# Altium schematic sheet Serial.SchDoc: Apalis Evaluation Board 1.1
size A3; Organization: Toradex AG; Address1: Altsagenstrasse 5; Address2: Horw; Address3: 6048; Address4: Switzerland; DocumentNumber: 24; Revision: V1.1; SheetNumber: 24; SheetTotal: 32; PageSetup: Record=PageOptions|CenterHorizontal=True|CenterVertical=True|PrintScale=0.73|XCorrection=1.00|YCorrection=1.00|PrintKind=0|BorderSize=5000000|LeftOffset=0|BottomOffset=0|Orientation=2|PaperLength=1000|PaperWidth=1000|Scale=100|PaperSource=7|PrintQuality=-4|MediaType=1|DitherType=10|PaperKind=A4|PrintScaleMode=1
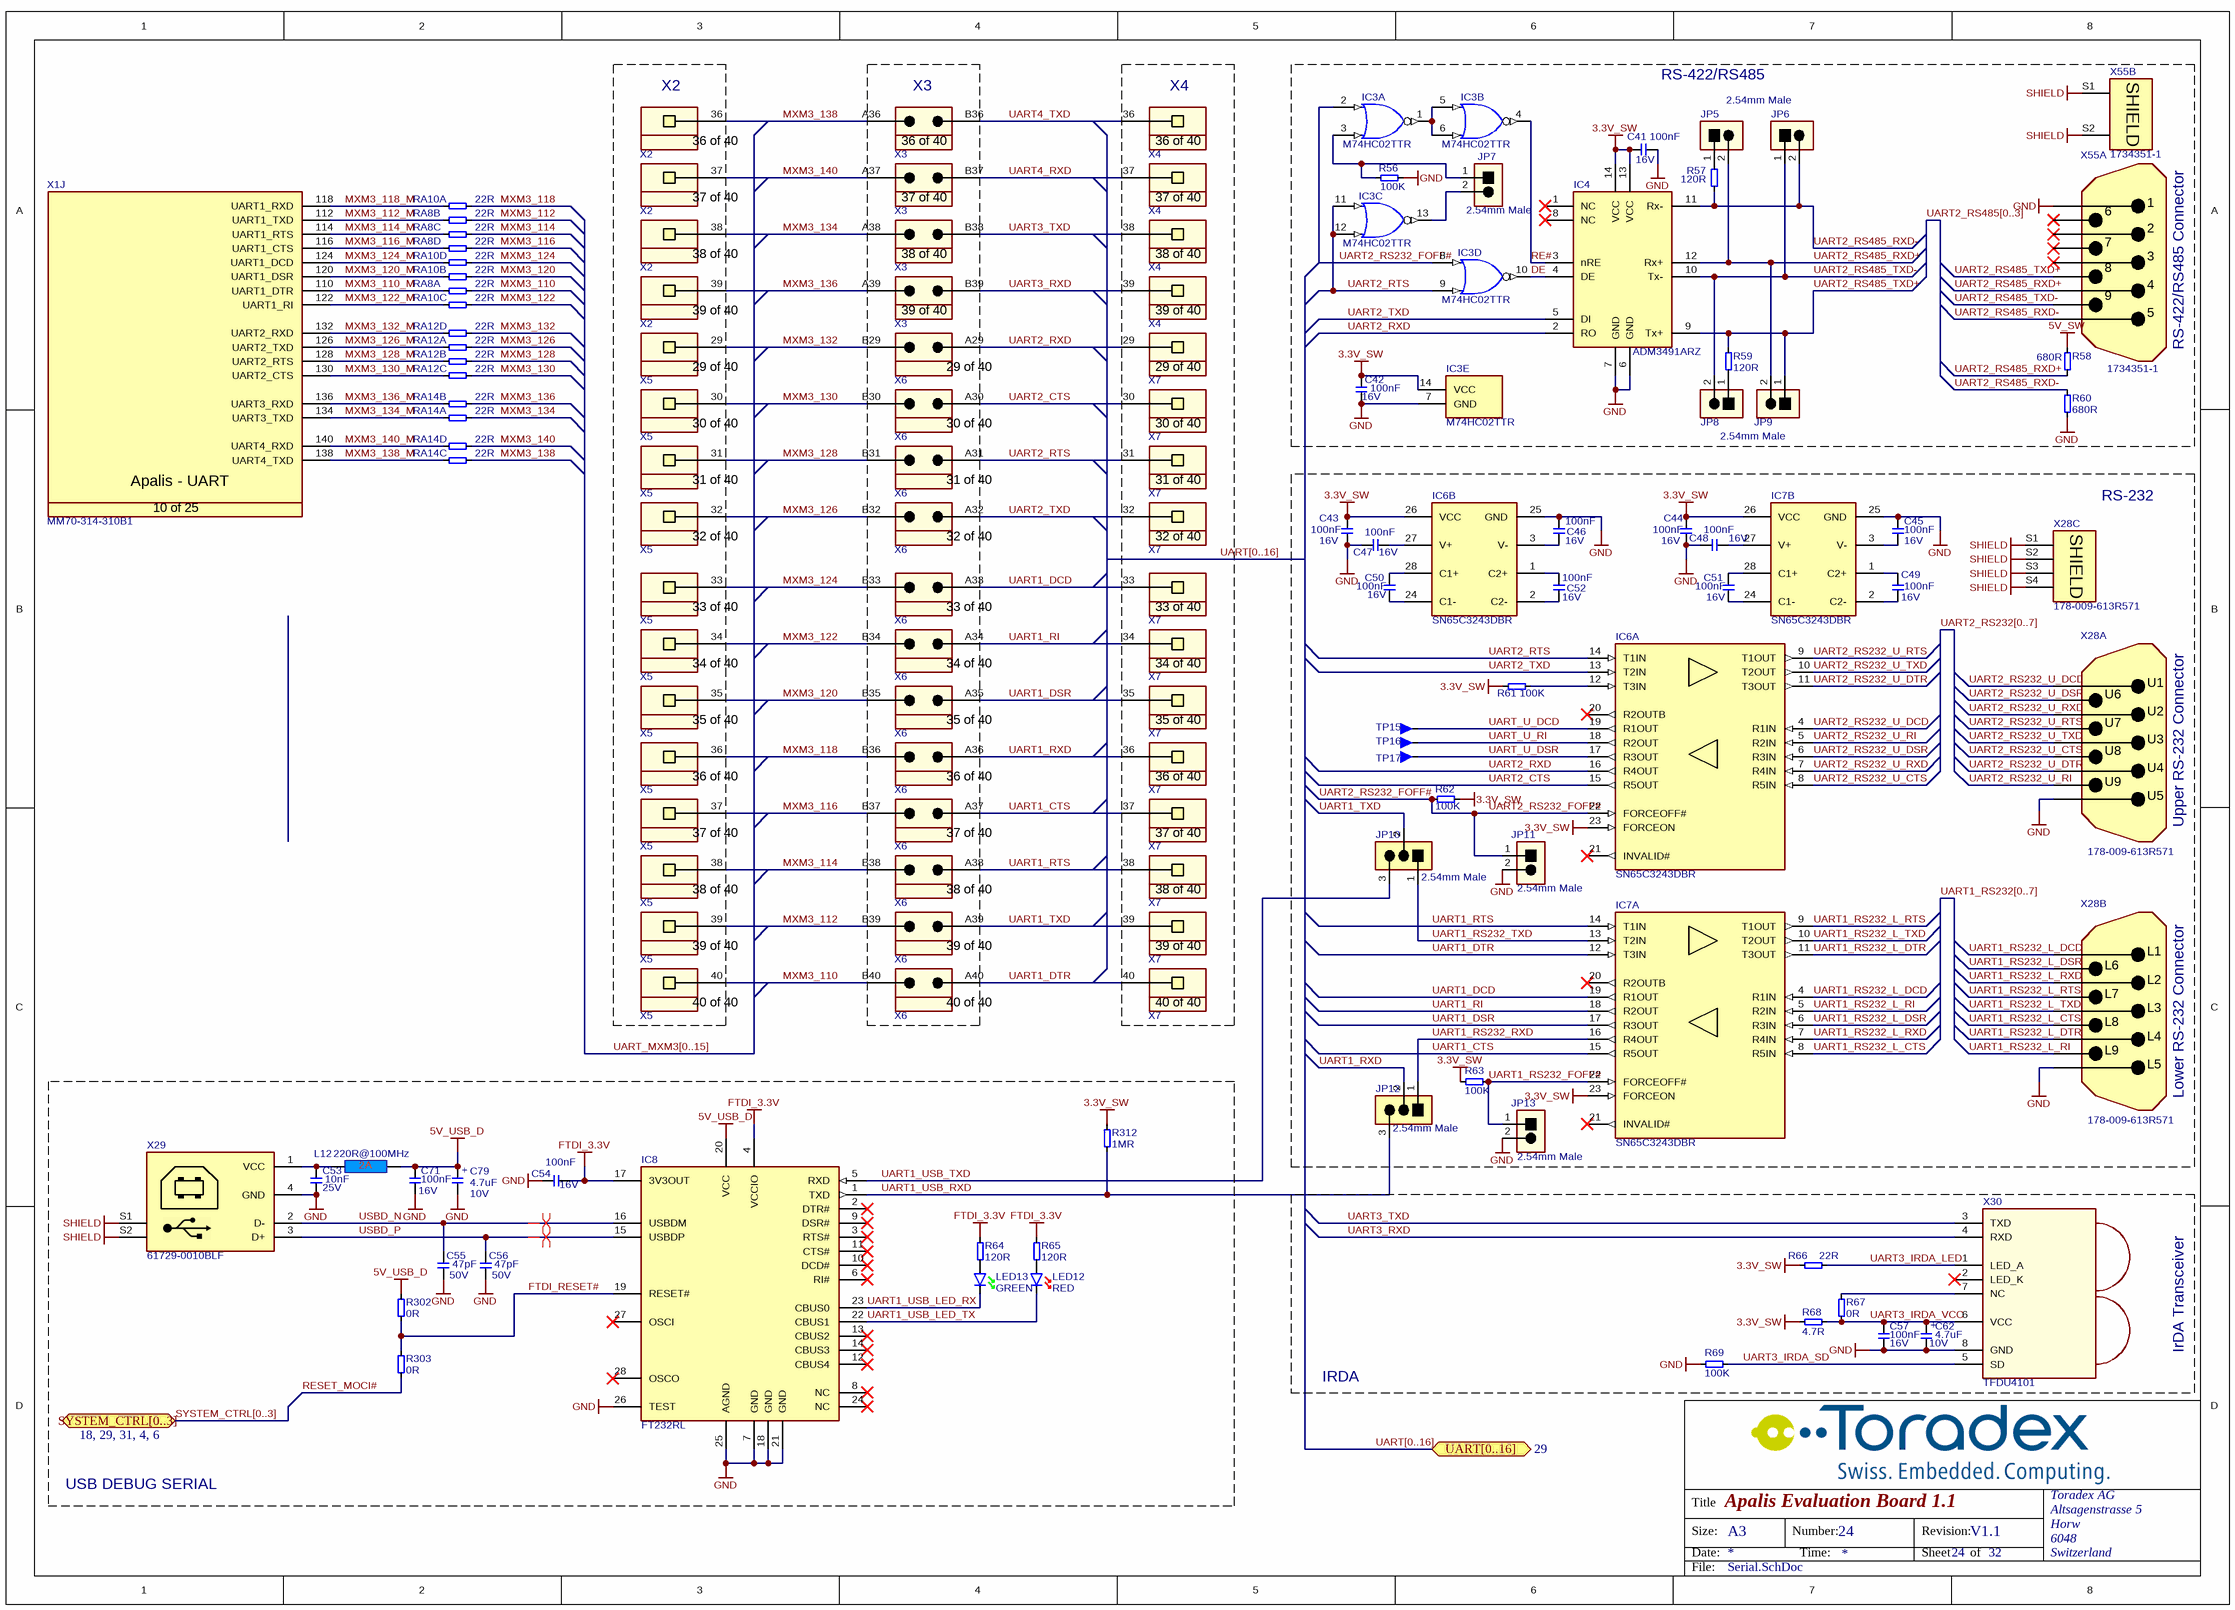
[diagram p0: Serial.SchDoc]

## Parts
C41  Rating: 16V  [T_CAPC0603X33N]  (hidden comment: 100nF)
C42  Rating: 16V  [T_CAPC0603X33N]  (hidden comment: 100nF)
C43  Rating: 16V  [T_CAPC0603X33N]  (hidden comment: 100nF)
C44  Rating: 16V  [T_CAPC0603X33N]  (hidden comment: 100nF)
C45  Rating: 16V  [T_CAPC0603X33N]  (hidden comment: 100nF)
C46  Rating: 16V  [T_CAPC0603X33N]  (hidden comment: 100nF)
C47  Rating: 16V  [T_CAPC0603X33N]  (hidden comment: 100nF)
C48  Rating: 16V  [T_CAPC0603X33N]  (hidden comment: 100nF)
C49  Rating: 16V  [T_CAPC0603X33N]  (hidden comment: 100nF)
C50  Rating: 16V  [T_CAPC0603X33N]  (hidden comment: 100nF)
C51  Rating: 16V  [T_CAPC0603X33N]  (hidden comment: 100nF)
C52  Rating: 16V  [T_CAPC0603X33N]  (hidden comment: 100nF)
C53  Rating: 25V  [T_CAPC0603X33N]  (hidden comment: 10nF)
C54  Rating: 16V  [T_CAPC0603X33N]  (hidden comment: 100nF)
C55  Rating: 50V  [T_CAPC0603X33N]  (hidden comment: 47pF)
C56  Rating: 50V  [T_CAPC0603X33N]  (hidden comment: 47pF)
C57  Rating: 16V  [T_CAPC0603X33N]  (hidden comment: 100nF)
C62  Rating: 10V  [T_CAPMP3216X180N]  (hidden comment: 4.7uF)
C71  Rating: 16V  [T_CAPC0603X33N]  (hidden comment: 100nF)
C79  Rating: 10V  [T_CAPMP3216X180N]  (hidden comment: 4.7uF)
IC3  M74HC02TTR  [T_ST_M74HC02TTR]  (parts A,B,C,D,E of 5)
IC4  ADM3491ARZ  [SOIC127P600X175-14N]
IC6  SN65C3243DBR  [SOP65P780X200-28N]  (parts A,B of 2)
IC7  SN65C3243DBR  [SOP65P780X200-28N]  (parts A,B of 2)
IC8  FT232RL  [T_FTDI_FT232RL]
JP5  TSW-101-07-G-D  [T_Samtec_TSW-101-07-G-D]  (value not drawn)
JP6  TSW-101-07-G-D  [T_Samtec_TSW-101-07-G-D]  (value not drawn)
JP7  TSW-101-07-G-D  [T_Samtec_TSW-101-07-G-D]  (value not drawn)
JP8  TSW-101-07-G-D  [T_Samtec_TSW-101-07-G-D]  (value not drawn)
JP9  TSW-101-07-G-D  [T_Samtec_TSW-101-07-G-D]  (value not drawn)
JP10  826936-3  [T_TYCO_826936-3]  (value not drawn)
JP11  TSW-101-07-G-D  [T_Samtec_TSW-101-07-G-D]  (value not drawn)
JP12  826936-3  [T_TYCO_826936-3]  (value not drawn)
JP13  TSW-101-07-G-D  [T_Samtec_TSW-101-07-G-D]  (value not drawn)
L12  220R@100MHz  [INDC1608X95N]
LED12  Color: RED  [T_Osram_T670_RED]  (hidden comment: LS T670-K1L2-1)
LED13  Color: GREEN  [T_Osram_T670_GREEN]  (hidden comment: LG T670-K1L2-1)
R56  100K  [T_RESC0603X30N]
R57  120R  [T_RESC0603X30N]
R58  680R  [T_RESC0603X30N]
R59  120R  [T_RESC0603X30N]
R60  680R  [T_RESC0603X30N]
R61  100K  [T_RESC0603X30N]
R62  100K  [T_RESC0603X30N]
R63  100K  [T_RESC0603X30N]
R64  120R  [T_RESC0603X30N]
R65  120R  [T_RESC0603X30N]
R66  22R  [T_RESC0603X30N]
R67  0R  [T_RESC0603X30N]
R68  4.7R  [RESC1005X40N]
R69  100K  [T_RESC0603X30N]
R302  0R  [T_RESC0603X30N]
R303  0R  [T_RESC0603X30N]
R312  1MR  [T_RESC0603X30N]
RA8  22R  [T_Resistor_Array_X4]  (parts A,B,C,D of 4)
RA10  22R  [T_Resistor_Array_X4]  (parts A,B,C,D of 4)
RA12  22R  [T_Resistor_Array_X4]  (parts A,B,C,D of 4)
RA14  22R  [T_Resistor_Array_X4]  (parts A,B,C,D of 4)
TP15  Testpin  [T_TP-THT]  (value not drawn)
TP16  Testpin  [T_TP-THT]  (value not drawn)
TP17  Testpin  [T_TP-THT]  (value not drawn)
X1  Manufacturer Part No.: MM70-314-310B1  [T_JAE_MM70-314-310B1]  (hidden comment: CON-JAE-MM70-314-310B1-314-0.5mm)  (part J of 25)
X2  SSW-110-01-G-S  [T_Samtec_SSW-110-01-G-S]  (value not drawn)  (parts 36,37,38,39 of 40)
X3  TSW-110-07-G-D  [T_Samtec_TSW-110-07-G-D]  (value not drawn)  (parts 36,37,38,39 of 40)
X4  SSW-110-01-G-S  [T_Samtec_SSW-110-01-G-S]  (value not drawn)  (parts 36,37,38,39 of 40)
X5  SSW-110-01-G-S  [T_Samtec_SSW-110-01-G-S]  (value not drawn)  (parts 29,30,31,32,33,34,35,36,37,38,39,40 of 40)
X6  TSW-110-07-G-D  [T_Samtec_TSW-110-07-G-D]  (value not drawn)  (parts 29,30,31,32,33,34,35,36,37,38,39,40 of 40)
X7  SSW-110-01-G-S  [T_Samtec_SSW-110-01-G-S]  (value not drawn)  (parts 29,30,31,32,33,34,35,36,37,38,39,40 of 40)
X28  178-009-613R571  [T_NorComp_178-YYY-613R691]  (parts A,B,C of 3)
X29  61729-0010BLF  [T_FCI_61729-0010BLF]
X30  Manufacturer Part No.: TFDU4101  [T_Vishay_TFDU4101]  (hidden comment: IF-Vishay-TFDU4101)
X55  1734351-1  [T_TECon_1734351-1]  (parts A,B of 2)

## Blocks framed on the sheet
X2: X2 X5
X3: X3 X6
X4: X4 X7
USB DEBUG SERIAL: C53-C56 C71 C79 IC8 L12 LED12 LED13 R64 R65 R302 R303 R312 X29

## Ports
SYSTEM_CTRL[0..3] (bidir, see 18, 29, 31, 4, 6), UART[0..16] (bidir, see 29)

## Nets
3.3V_SW: C41.1 C42.2 C43.2 C44.2 IC3.14(VCC) IC4.13(VCC) IC4.14(VCC) IC6.23(FORCEON) IC6.26(VCC) IC7.23(FORCEON) IC7.26(VCC) R61.1 R62.2 R63.1 R66.1 R68.1 R312.2
5V_SW: R58.2
5V_USB_D: C71.2 C79.1 IC8.20(VCC) L12.2 R302.2
FTDI_3.3V: C54.2 IC8.4(VCCIO) IC8.17(3V3OUT) R64.2 R65.2
GND: C41.2 C42.1 C43.1 C44.1 C45.2 C46.2 C47.1 C48.1 C53.1 C54.1 C55.1 C56.1 C57.1 C62.2 C71.1 C79.2 IC3.7(GND) IC4.6(GND) IC4.7(GND) IC6.25(GND) IC7.25(GND) IC8.7(GND) IC8.18(GND) IC8.21(GND) IC8.25(AGND) IC8.26(TEST) JP11.2 JP13.2 R56.1 R60.1 R69.1 X28.L5(GND) X28.U5(GND) X29.4(GND) X30.8(GND) X55.1(DCD)
SHIELD: X28.S1(SHIELD) X28.S2(SHIELD) X28.S3(SHIELD) X28.S4(SHIELD) X29.S1 X29.S2 X55.S1(SHIELD) X55.S2(SHIELD)
DE: IC3.10(~{O}) IC4.4(DE)
FTDI_RESET#: IC8.19(RESET#) R302.1 R303.2
MXM3_110: RA8.5 X5.40 X6.B40
MXM3_110_M: RA8.1 X1.110(UART1_DTR)
MXM3_112: RA8.6 X5.39 X6.B39
MXM3_112_M: RA8.2 X1.112(UART1_TXD)
MXM3_114: RA8.7 X5.38 X6.B38
MXM3_114_M: RA8.3 X1.114(UART1_RTS)
MXM3_116: RA8.8 X5.37 X6.B37
MXM3_116_M: RA8.4 X1.116(UART1_CTS)
MXM3_118: RA10.5 X5.36 X6.B36
MXM3_118_M: RA10.1 X1.118(UART1_RXD)
MXM3_120: RA10.6 X5.35 X6.B35
MXM3_120_M: RA10.2 X1.120(UART1_DSR)
MXM3_122: RA10.7 X5.34 X6.B34
MXM3_122_M: RA10.3 X1.122(UART1_RI)
MXM3_124: RA10.8 X5.33 X6.B33
MXM3_124_M: RA10.4 X1.124(UART1_DCD)
MXM3_126: RA12.5 X5.32 X6.B32
MXM3_126_M: RA12.1 X1.126(UART2_TXD)
MXM3_128: RA12.6 X5.31 X6.B31
MXM3_128_M: RA12.2 X1.128(UART2_RTS)
MXM3_130: RA12.7 X5.30 X6.B30
MXM3_130_M: RA12.3 X1.130(UART2_CTS)
MXM3_132: RA12.8 X5.29 X6.B29
MXM3_132_M: RA12.4 X1.132(UART2_RXD)
MXM3_134: RA14.5 X2.38 X3.A38
MXM3_134_M: RA14.1 X1.134(UART3_TXD)
MXM3_136: RA14.6 X2.39 X3.A39
MXM3_136_M: RA14.2 X1.136(UART3_RXD)
MXM3_138: RA14.7 X2.36 X3.A36
MXM3_138_M: RA14.3 X1.138(UART4_TXD)
MXM3_140: RA14.8 X2.37 X3.A37
MXM3_140_M: RA14.4 X1.140(UART4_RXD)
RE#: IC3.4(~{O}) IC4.3(nRE)
RESET_MOCI#: R303.1
UART1_CTS: IC7.15(R5OUT) X6.A37 X7.37
UART1_DCD: IC7.19(R1OUT) X6.A33 X7.33
UART1_DSR: IC7.17(R3OUT) X6.A35 X7.35
UART1_DTR: IC7.12(T3IN) X6.A40 X7.40
UART1_RI: IC7.18(R2OUT) X6.A34 X7.34
UART1_RS232_FOFF#: IC7.22(FORCEOFF#) JP13.1 R63.2
UART1_RS232_L_CTS: IC7.8(R5IN) X28.L8(CTS)
UART1_RS232_L_DCD: IC7.4(R1IN) X28.L1(DCD)
UART1_RS232_L_DSR: IC7.6(R3IN) X28.L6(DSR)
UART1_RS232_L_DTR: IC7.11(T3OUT) X28.L4(DTR)
UART1_RS232_L_RI: IC7.5(R2IN) X28.L9(RI)
UART1_RS232_L_RTS: IC7.9(T1OUT) X28.L7(RTS)
UART1_RS232_L_RXD: IC7.7(R4IN) X28.L2(RXD)
UART1_RS232_L_TXD: IC7.10(T2OUT) X28.L3(TXD)
UART1_RS232_RXD: IC7.16(R4OUT) JP12.1
UART1_RS232_TXD: IC7.13(T2IN) JP10.1
UART1_RTS: IC7.14(T1IN) X6.A38 X7.38
UART1_RXD: JP12.2 X6.A36 X7.36
UART1_TXD: JP10.2 X6.A39 X7.39
UART1_USB_LED_RX: IC8.23(CBUS0) LED13.K
UART1_USB_LED_TX: IC8.22(CBUS1) LED12.K
UART1_USB_RXD: IC8.1(TXD) JP12.3 R312.1
UART1_USB_TXD: IC8.5(RXD) JP10.3
UART2_CTS: IC6.15(R5OUT) X6.A30 X7.30
UART2_RS232_FOFF#: IC3.2(A) IC3.8(A) IC6.22(FORCEOFF#) JP11.1 R62.1
UART2_RS232_U_CTS: IC6.8(R5IN) X28.U8(CTS)
UART2_RS232_U_DCD: IC6.4(R1IN) X28.U1(DCD)
UART2_RS232_U_DSR: IC6.6(R3IN) X28.U6(DSR)
UART2_RS232_U_DTR: IC6.11(T3OUT) X28.U4(DTR)
UART2_RS232_U_RI: IC6.5(R2IN) X28.U9(RI)
UART2_RS232_U_RTS: IC6.9(T1OUT) X28.U7(RTS)
UART2_RS232_U_RXD: IC6.7(R4IN) X28.U2(RXD)
UART2_RS232_U_TXD: IC6.10(T2OUT) X28.U3(TXD)
UART2_RS485_RXD+: IC4.12(Rx+) JP5.2 JP9.2 R58.1 X55.4(DTR)
UART2_RS485_RXD-: IC4.11(Rx-) JP6.2 R57.1 R60.2 X55.5(GND)
UART2_RS485_TXD+: IC4.9(Tx+) JP9.1 R59.2 X55.8(CTS)
UART2_RS485_TXD-: IC4.10(Tx-) JP6.1 JP8.2 X55.9(RI)
UART2_RTS: IC3.9(B) IC3.11(A) IC3.12(B) IC6.14(T1IN) X6.A31 X7.31
UART2_RXD: IC4.2(RO) IC6.16(R4OUT) X6.A29 X7.29
UART2_TXD: IC4.5(DI) IC6.13(T2IN) X6.A32 X7.32
UART3_IRDA_LED: R66.2 X30.1(LED_A)
UART3_IRDA_SD: R69.2 X30.5(SD)
UART3_IRDA_VCC: C57.2 C62.1 R67.1 R68.2 X30.6(VCC)
UART3_RXD: X3.B39 X4.39 X30.4(RXD)
UART3_TXD: X3.B38 X4.38 X30.3(TXD)
UART4_RXD: X3.B37 X4.37
UART4_TXD: X3.B36 X4.36
UART_U_DCD: IC6.19(R1OUT) TP15.1
UART_U_DSR: IC6.17(R3OUT) TP17.1
UART_U_RI: IC6.18(R2OUT) TP16.1
USBD_N: C55.2 IC8.16(USBDM) X29.2(D-)
USBD_P: C56.2 IC8.15(USBDP) X29.3(D+)
NetC45_1: C45.1 IC7.3(V-)
NetC46_1: C46.1 IC6.3(V-)
NetC47_2: C47.2 IC6.27(V+)
NetC48_2: C48.2 IC7.27(V+)
NetC49_1: C49.1 IC7.2(C2-)
NetC49_2: C49.2 IC7.1(C2+)
NetC50_1: C50.1 IC6.24(C1-)
NetC50_2: C50.2 IC6.28(C1+)
NetC51_1: C51.1 IC7.24(C1-)
NetC51_2: C51.2 IC7.28(C1+)
NetC52_1: C52.1 IC6.2(C2-)
NetC52_2: C52.2 IC6.1(C2+)
NetC53_2: C53.2 L12.1 X29.1(VCC)
NetIC3_1: IC3.1(~{O}) IC3.5(A) IC3.6(B)
NetIC3_3: IC3.3(B) JP7.1 R56.2
NetIC3_13: IC3.13(~{O}) JP7.2
NetIC6_12: IC6.12(T3IN) R61.2
NetJP5_1: JP5.1 R57.2
NetJP8_1: JP8.1 R59.1
NetLED12_A: LED12.A R65.1
NetLED13_A: LED13.A R64.1
NetR67_2: R67.2 X30.7(NC)

Not connected (* = marked no-connect by the designer): IC4 1(NC)* 8(NC)*; IC6 20(R2OUTB)* 21(INVALID#)*; IC7 20(R2OUTB)* 21(INVALID#)*; IC8 2(DTR#)* 3(RTS#)* 6(RI#)* 8(NC)* 9(DSR#)* 10(DCD#)* 11(CTS#)* 12(CBUS4)* 13(CBUS2)* 14(CBUS3)* 24(NC)* 27(OSCI)* 28(OSCO)*; X30 2(LED_K)*; X55 2(RXD)* 3(TXD)* 6(DSR)* 7(RTS)*

## Buses and harness runs
bus SYSTEM_CTRL[0..3] = port SYSTEM_CTRL[0..3]
bus UART1_RS232[0..7]
bus UART2_RS232[0..7]
bus UART2_RS485[0..3]
bus UART[0..16] = port UART[0..16]
bus UART_MXM3[0..15]

## Layout directives
differential pair: USBD_N, USBD_P

## Notes on the sheet
- RS-422/RS485
- 2.54mm Male
- (near JP7) 2.54mm Male
- RS-422/RS485 Connector
- RS-232
- Upper RS-232 Connector
- (near JP10) 2.54mm Male
- (near JP11) 2.54mm Male
- (near JP12) 2.54mm Male
- Lower RS-232 Connector
- (near JP13) 2.54mm Male
- IrDA Transceiver
- IRDA
- Title
- Size:
- Date:
- A3
- Number:
- Time:
- Revision:
- Sheet
- of
- File:
- (in symbol C-TA-4.7uF-10V-20%-3216) +
- (in symbol CON-JAE-MM70-314-310B1-314-0.5mm, part J) Apalis - UART; 10 of 25
- (in symbol CON-Samtec-SSW-110-01-G-S, part 29) 29 of 40
- (in symbol CON-Samtec-SSW-110-01-G-S, part 30) 30 of 40
- (in symbol CON-Samtec-SSW-110-01-G-S, part 31) 31 of 40
- (in symbol CON-Samtec-SSW-110-01-G-S, part 32) 32 of 40
- (in symbol CON-Samtec-SSW-110-01-G-S, part 33) 33 of 40
- (in symbol CON-Samtec-SSW-110-01-G-S, part 34) 34 of 40
- (in symbol CON-Samtec-SSW-110-01-G-S, part 35) 35 of 40
- (in symbol CON-Samtec-SSW-110-01-G-S, part 36) 36 of 40
- (in symbol CON-Samtec-SSW-110-01-G-S, part 37) 37 of 40
- (in symbol CON-Samtec-SSW-110-01-G-S, part 38) 38 of 40
- (in symbol CON-Samtec-SSW-110-01-G-S, part 39) 39 of 40
- (in symbol CON-Samtec-SSW-110-01-G-S, part 40) 40 of 40
- (in symbol CON-Samtec-TSW-110-07-G-D, part 29) 29 of 40
- (in symbol CON-Samtec-TSW-110-07-G-D, part 30) 30 of 40
- (in symbol CON-Samtec-TSW-110-07-G-D, part 31) 31 of 40
- (in symbol CON-Samtec-TSW-110-07-G-D, part 32) 32 of 40
- (in symbol CON-Samtec-TSW-110-07-G-D, part 33) 33 of 40
- (in symbol CON-Samtec-TSW-110-07-G-D, part 34) 34 of 40
- (in symbol CON-Samtec-TSW-110-07-G-D, part 35) 35 of 40
- (in symbol CON-Samtec-TSW-110-07-G-D, part 36) 36 of 40
- (in symbol CON-Samtec-TSW-110-07-G-D, part 37) 37 of 40
- (in symbol CON-Samtec-TSW-110-07-G-D, part 38) 38 of 40
- (in symbol CON-Samtec-TSW-110-07-G-D, part 39) 39 of 40
- (in symbol CON-Samtec-TSW-110-07-G-D, part 40) 40 of 40

## Library data of the parts
C41-C52 C54 C57 C71 = C-X7R-100nF-16V-10%-0603: Capacitor Ceramic X7R 100nF 16V 10% 0603; Tolerance: 10%; Type: X7R; Value: 100nF
C53 = C-X7R-10nF-25V-10%-0603: Capacitor Ceramic X7R 10nF 25V 10% 0603; Tolerance: 10%; Type: X7R; Value: 10nF
C55 C56 = C-NP0-47pF-50V-10%-0603: Capacitor Ceramic NP0 47pF 50V 10% 0603; Tolerance: 10%; Type: NP0; Value: 47pF
C62 C79 = C-TA-4.7uF-10V-20%-3216: Capacitor TA 4.7uF 10V 20% 3216; Tolerance: 20%; Type: TA; Value: 4.7uF
IC3 = IC-ST-M74HC02TTR: Quad 2-Input NOR Gate; Manufacturer Name: ST Microelectronics; Manufacturer part No.: M74HC02TTR
IC4 = IC-AD-ADM3491ARZ: ADM3491ARZ RS-485/RS-422 transceiver; Manufacturer Name: Analog Devices; Manufacturer Part No.: ADM3491ARZ
IC6 IC7 = IC-TI-SN65C3243DBR: RS-232 Serial Transceiver; Manufacturer Name: Texas Instruments; Manufacturer Part No.: SN65C3243DBR
IC8 = IC-FTDI-FT232RL: FT232R USB TO UART; Manufacturer Name: FTDI; Manufacturer Part No.: FT232RL
JP5-JP9 JP11 JP13 = CON-Samtec-TSW-101-07-G-D: Header male, 1x2 Pins, 2.54 mm pitch; Manufacturer Name: Samtec; Pitch: 2.54 mm; No. of ways: 1x2; Manufacturer Part no.: TSW-101-07-G-D
JP10 = CON-Tyco-826936-3-1X3-2.54mm-JP_1: Jumper, 3-Pin; Manufacturer Name: Tyco; No. of ways: 1X3; Pitch: 2.54mm; Manufacturer Part No.: 826936-3
JP12 = CON-Tyco-826936-3-1X3-2.54mm-JP_2: Jumper, 3-Pin; Manufacturer Name: Tyco; No. of ways: 1X3; Pitch: 2.54mm; Manufacturer Part No.: 826936-3
L12 = L-220R@100MHz-2A-25%-0603: 220R@100MHz 2A EMI FILTER; Tolerance: 25%; Rating: 2A; Value: 220R@100MHz
LED12 = LED-Osram-LS T670-K1L2-1: LED red, Osram LS T670-K1L2-1; Manufacturer Name: Osram; Manufacturer Part No.: LS T670-K1L2-1
LED13 = LED-Osram-T670-K1L2-1: LED green Osram LG T670-K1L2-1; Manufacturer Name: Osram; Manufacturer Part No.: LG T670-K1L2-1
R56 R61-R63 R69 = R-100KR-63mW-5%-0603: Resistor 100 Kohm 63mW 5% 0603; Value: 100KR; Rating: 63mW; Tolerance: 5%
R57 R59 R64 R65 = R-120R-63mW-5%-0603: Resistor 120 ohm 63mW 5% 0603; Rating: 63mW; Tolerance: 5%; Value: 120R
R58 R60 = R-680R-63mW-5%-0603: Resistor 680 ohm 63mW 5% 0603; Rating: 63mW; Tolerance: 5%; Value: 680R
R66 = R-22R-63mW-5%-0603: Resistor 22 ohm 63mW 5% 0603; Rating: 63mW; Tolerance: 5%; Value: 22R
R67 R302 R303 = R-0R-63mW-1%-0603: Resistor 0 ohm 63mW 1% 0603; Rating: 63mW; Tolerance: 1%; Value: 0R
R68 = R-4.7R-63mW-5%-0402: Resistor 4.7 ohm 63mW 5% 0402; Rating: 63mW; Tolerance: 5%; Value: 4.7R
R312 = R-1MR-63mW-5%-0603: Resistor 1Mohm 63mW 5% 0603; Rating: 63mW; Tolerance: 5%; Value: 1MR
RA8 RA10 RA12 RA14 = RA-22R-63mW-5%-1206-div: Resistor Array 22 R 63mW 5% 1206; Tolerance: 5%; Power Dissipation: 63mW; Value: 22R
TP15-TP17 = Testpin: Testpin TH
X1 = CON-JAE-MM70-314-310B1-314-0.5mm: MXM3 Connector; Manufacturer Name: JAE; No. of ways: 314
X2 X4 X5 X7 = CON-Samtec-SSW-110-01-G-S: Receptacle Female Socket 1x40 pin 2.54mm pitch; Manufacturer Name: Samtec; Pitch: 2.54mm; No. of ways: 1x40; Manufacturer Part No.: SSW-110-01-G-S
X3 X6 = CON-Samtec-TSW-110-07-G-D: Header 2x40 pin 2.54mm pitch; Manufacturer Name: Samtec; Pitch: 2.54mm; No. of ways: 2x40; Manufacturer Part No.: TSW-110-07-G-D
X28 = CON-NorComp-178-009-613R571: RS232 Connector 9 pins male; No. of Ways: 18; Manufacturer Name: NorComp; Manufacturer Part No.: 178-009-613R571
X29 = CON-FCI-61729-0010BLF: USB Type B Connector; Manufacturer Name: FCI; No. of ways: 4; Manufacturer Part No.: 61729-0010BLF
X30 = IF-Vishay-TFDU4101: Vishay TFDU4101 Infrared Transceiver; Manufacturer Name: Vishay
X55 = CON-TECon-1734351-1: 9 pin male D-SUB connector; Manufacturer Name: TE Connectivity; No. of ways: 9; Manufacturer Part No.: 1734351-1